# EasyEDA Pro project ProPrj_Avaota A1 八核 AIoT 开发板_2024-05-03.epro, schematic Avaota Pi A, sheets 6 to 13 of 13

## Sheets
6 PERF1
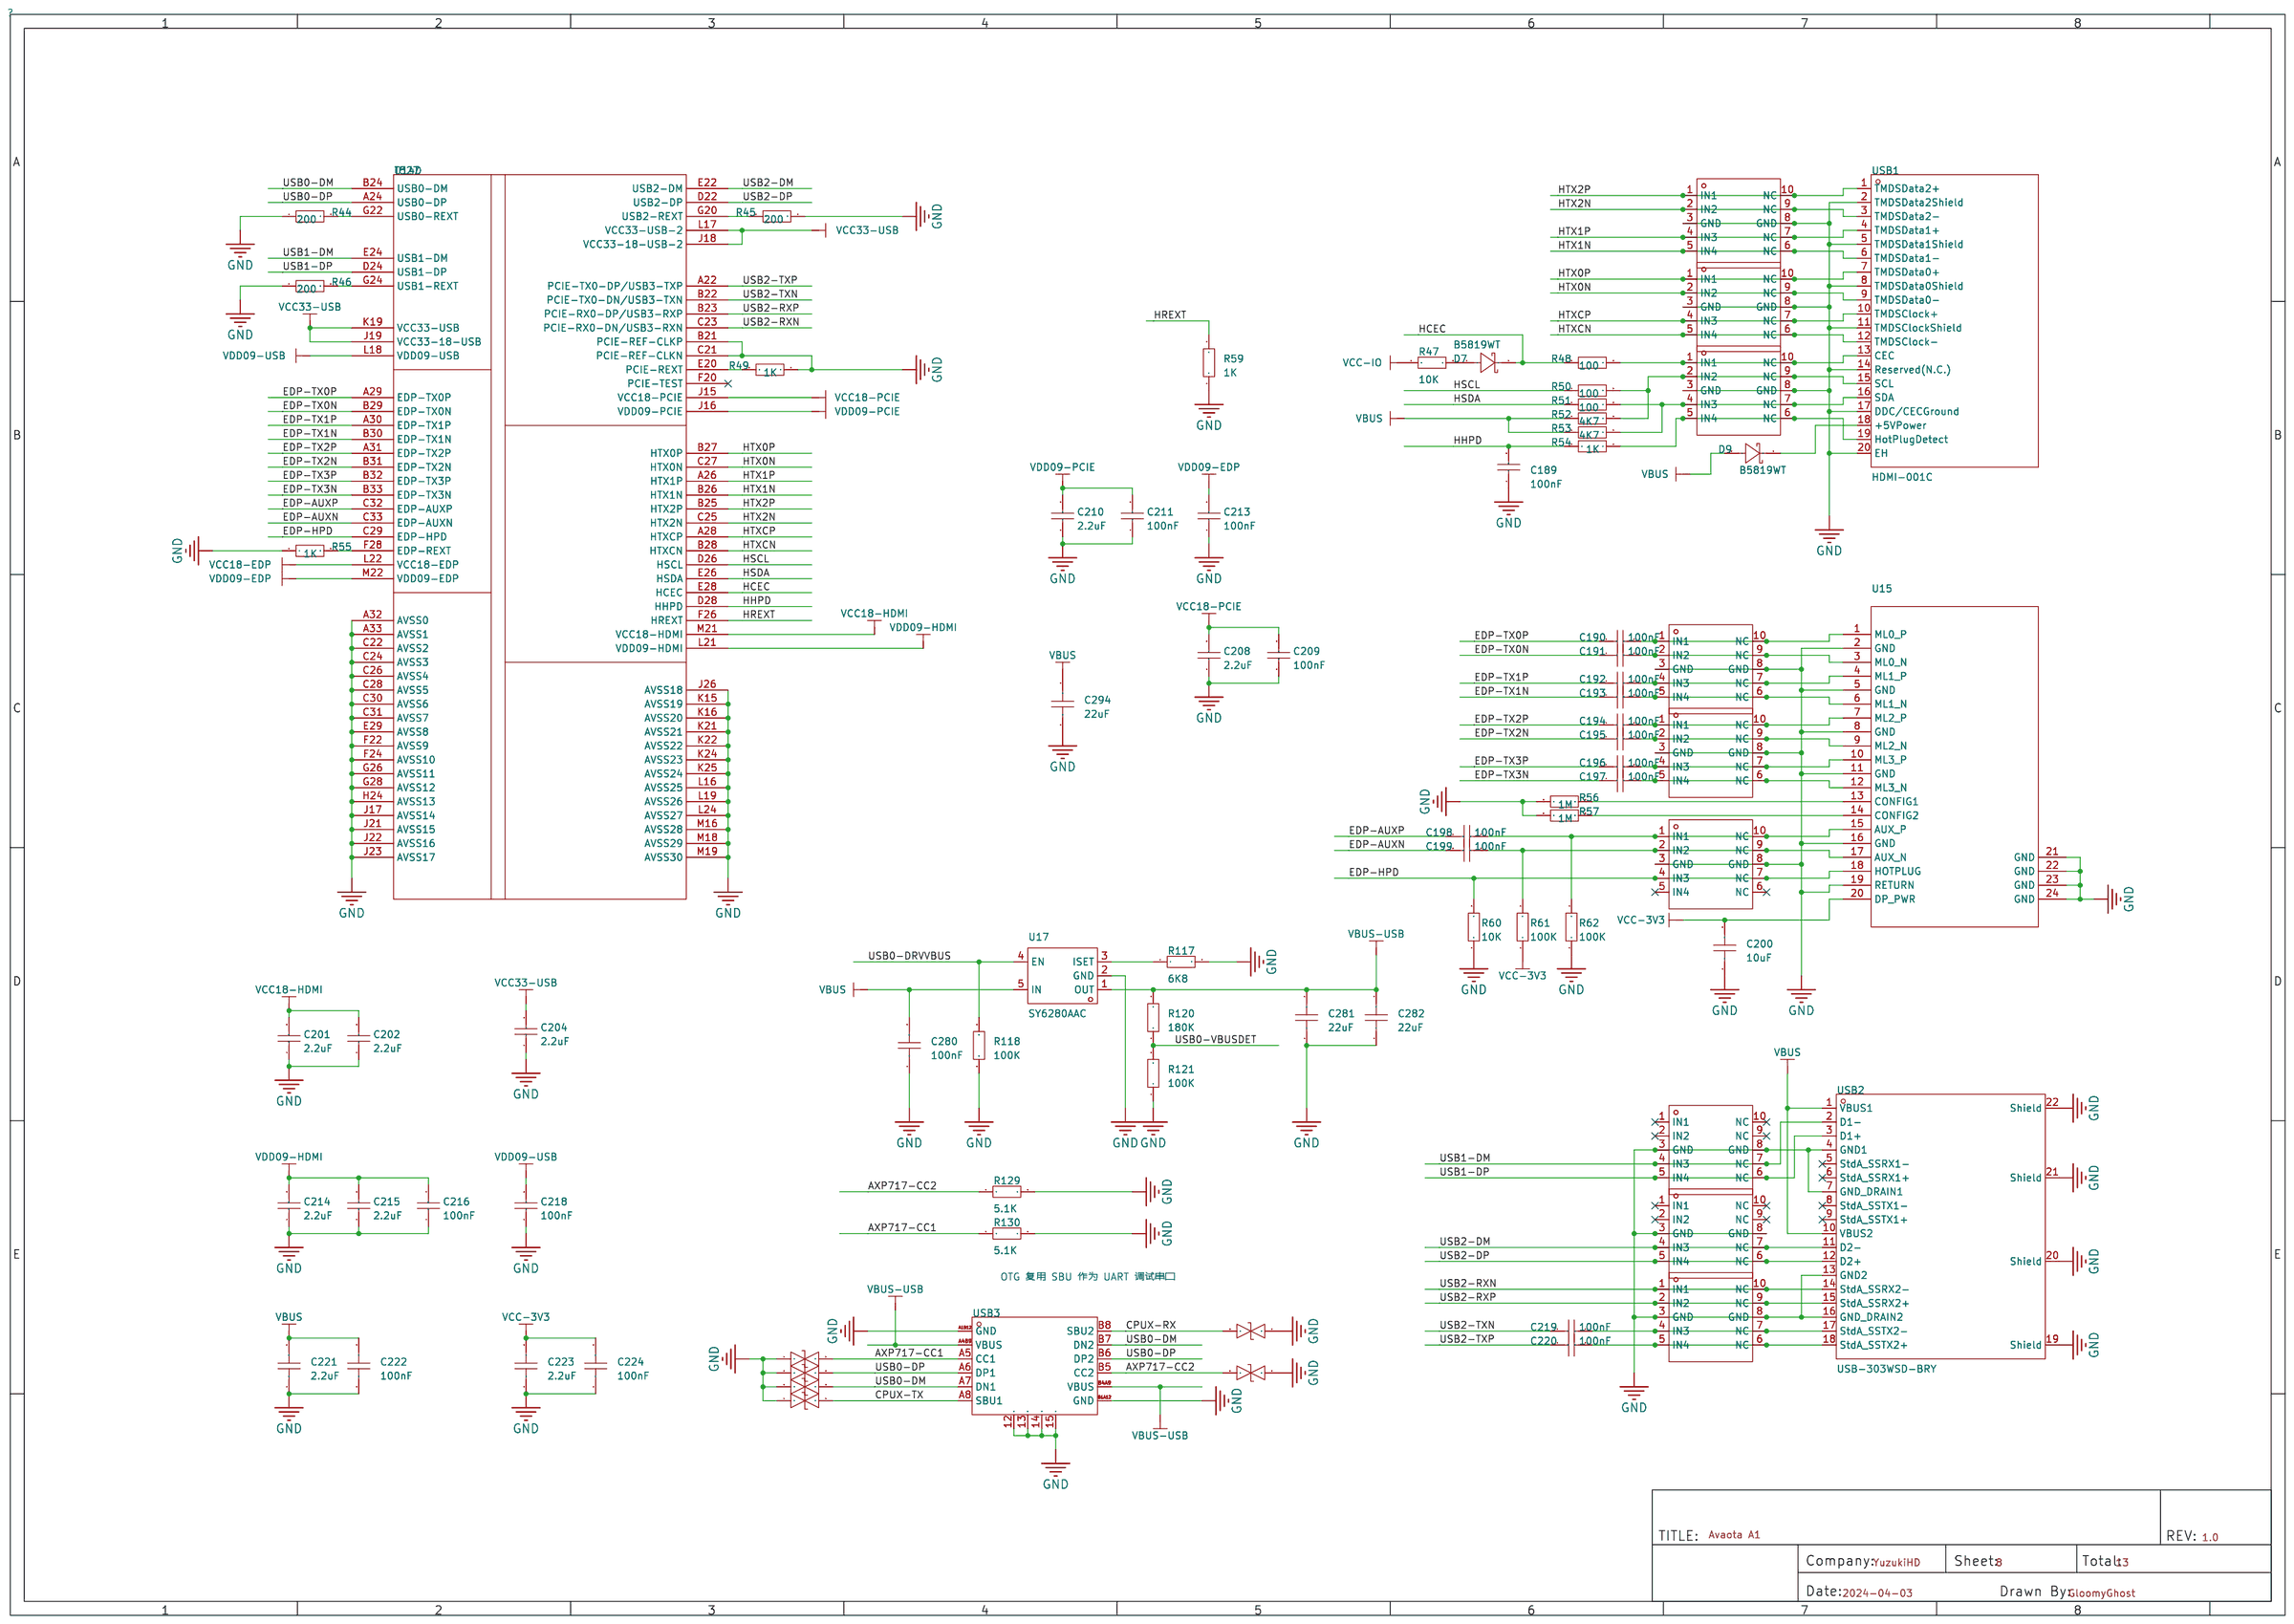
[diagram p5: PERF1]
7 BLOCK
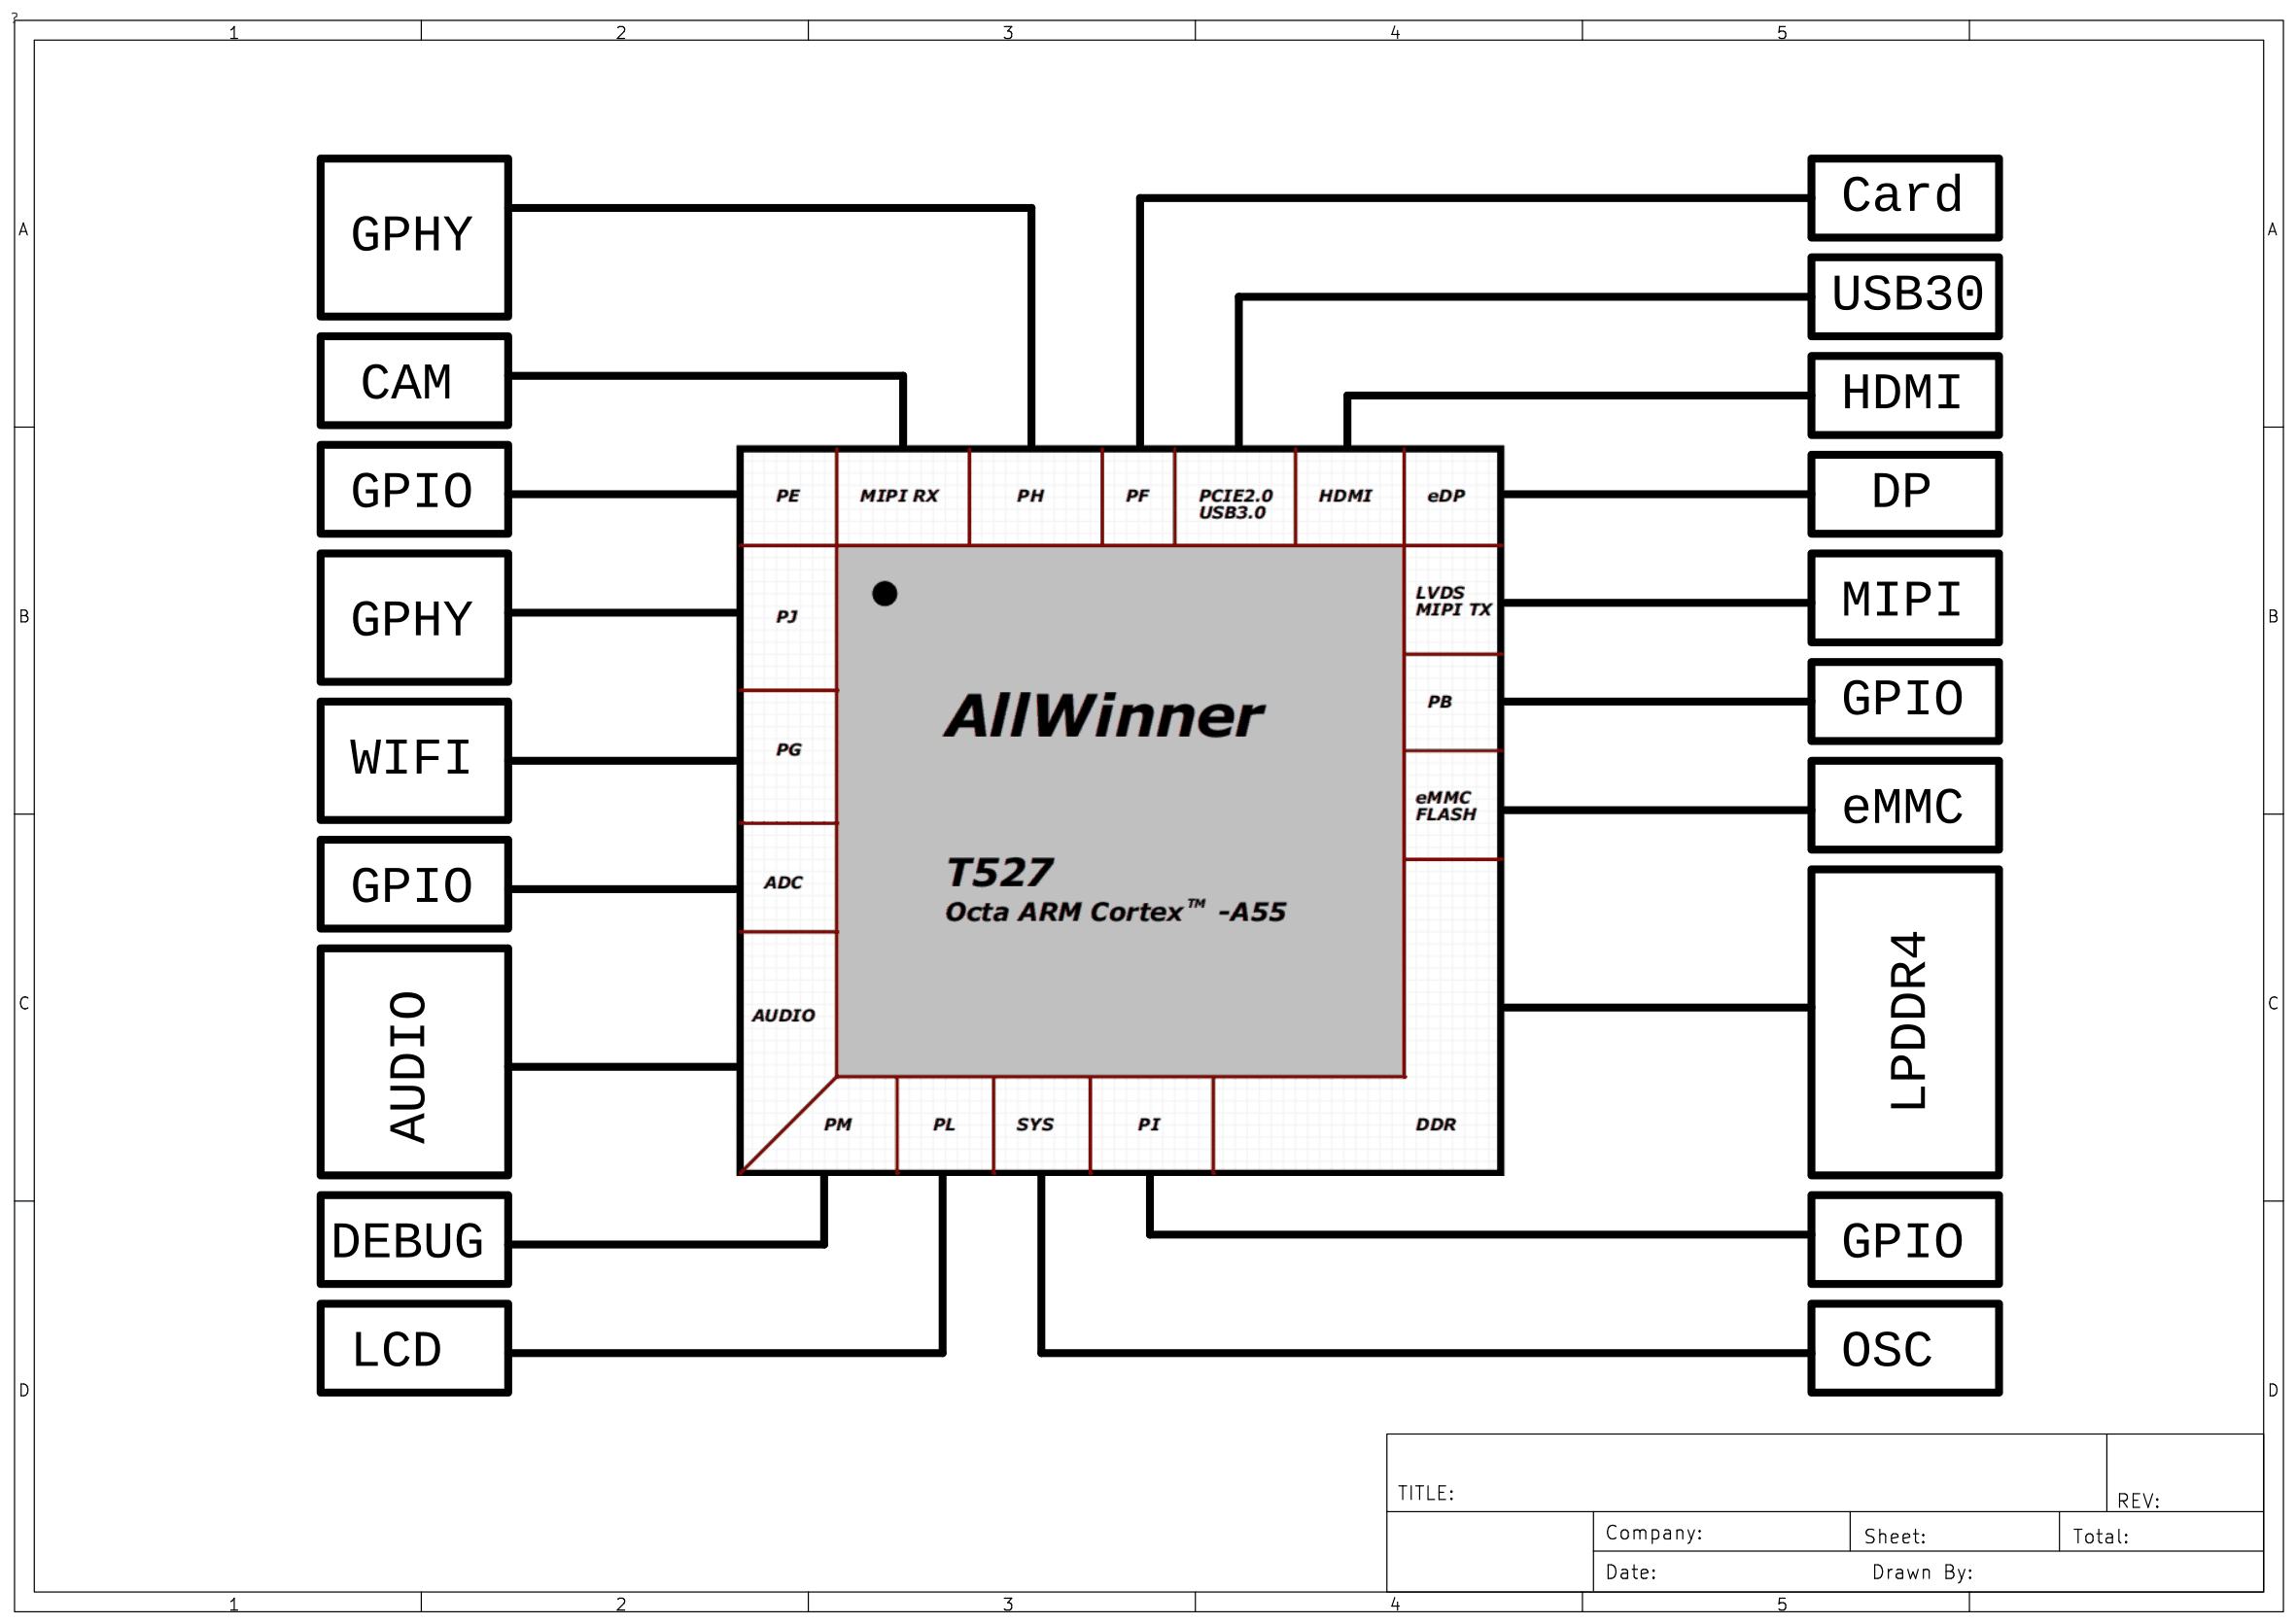
[diagram p6: BLOCK]
8 PERF2
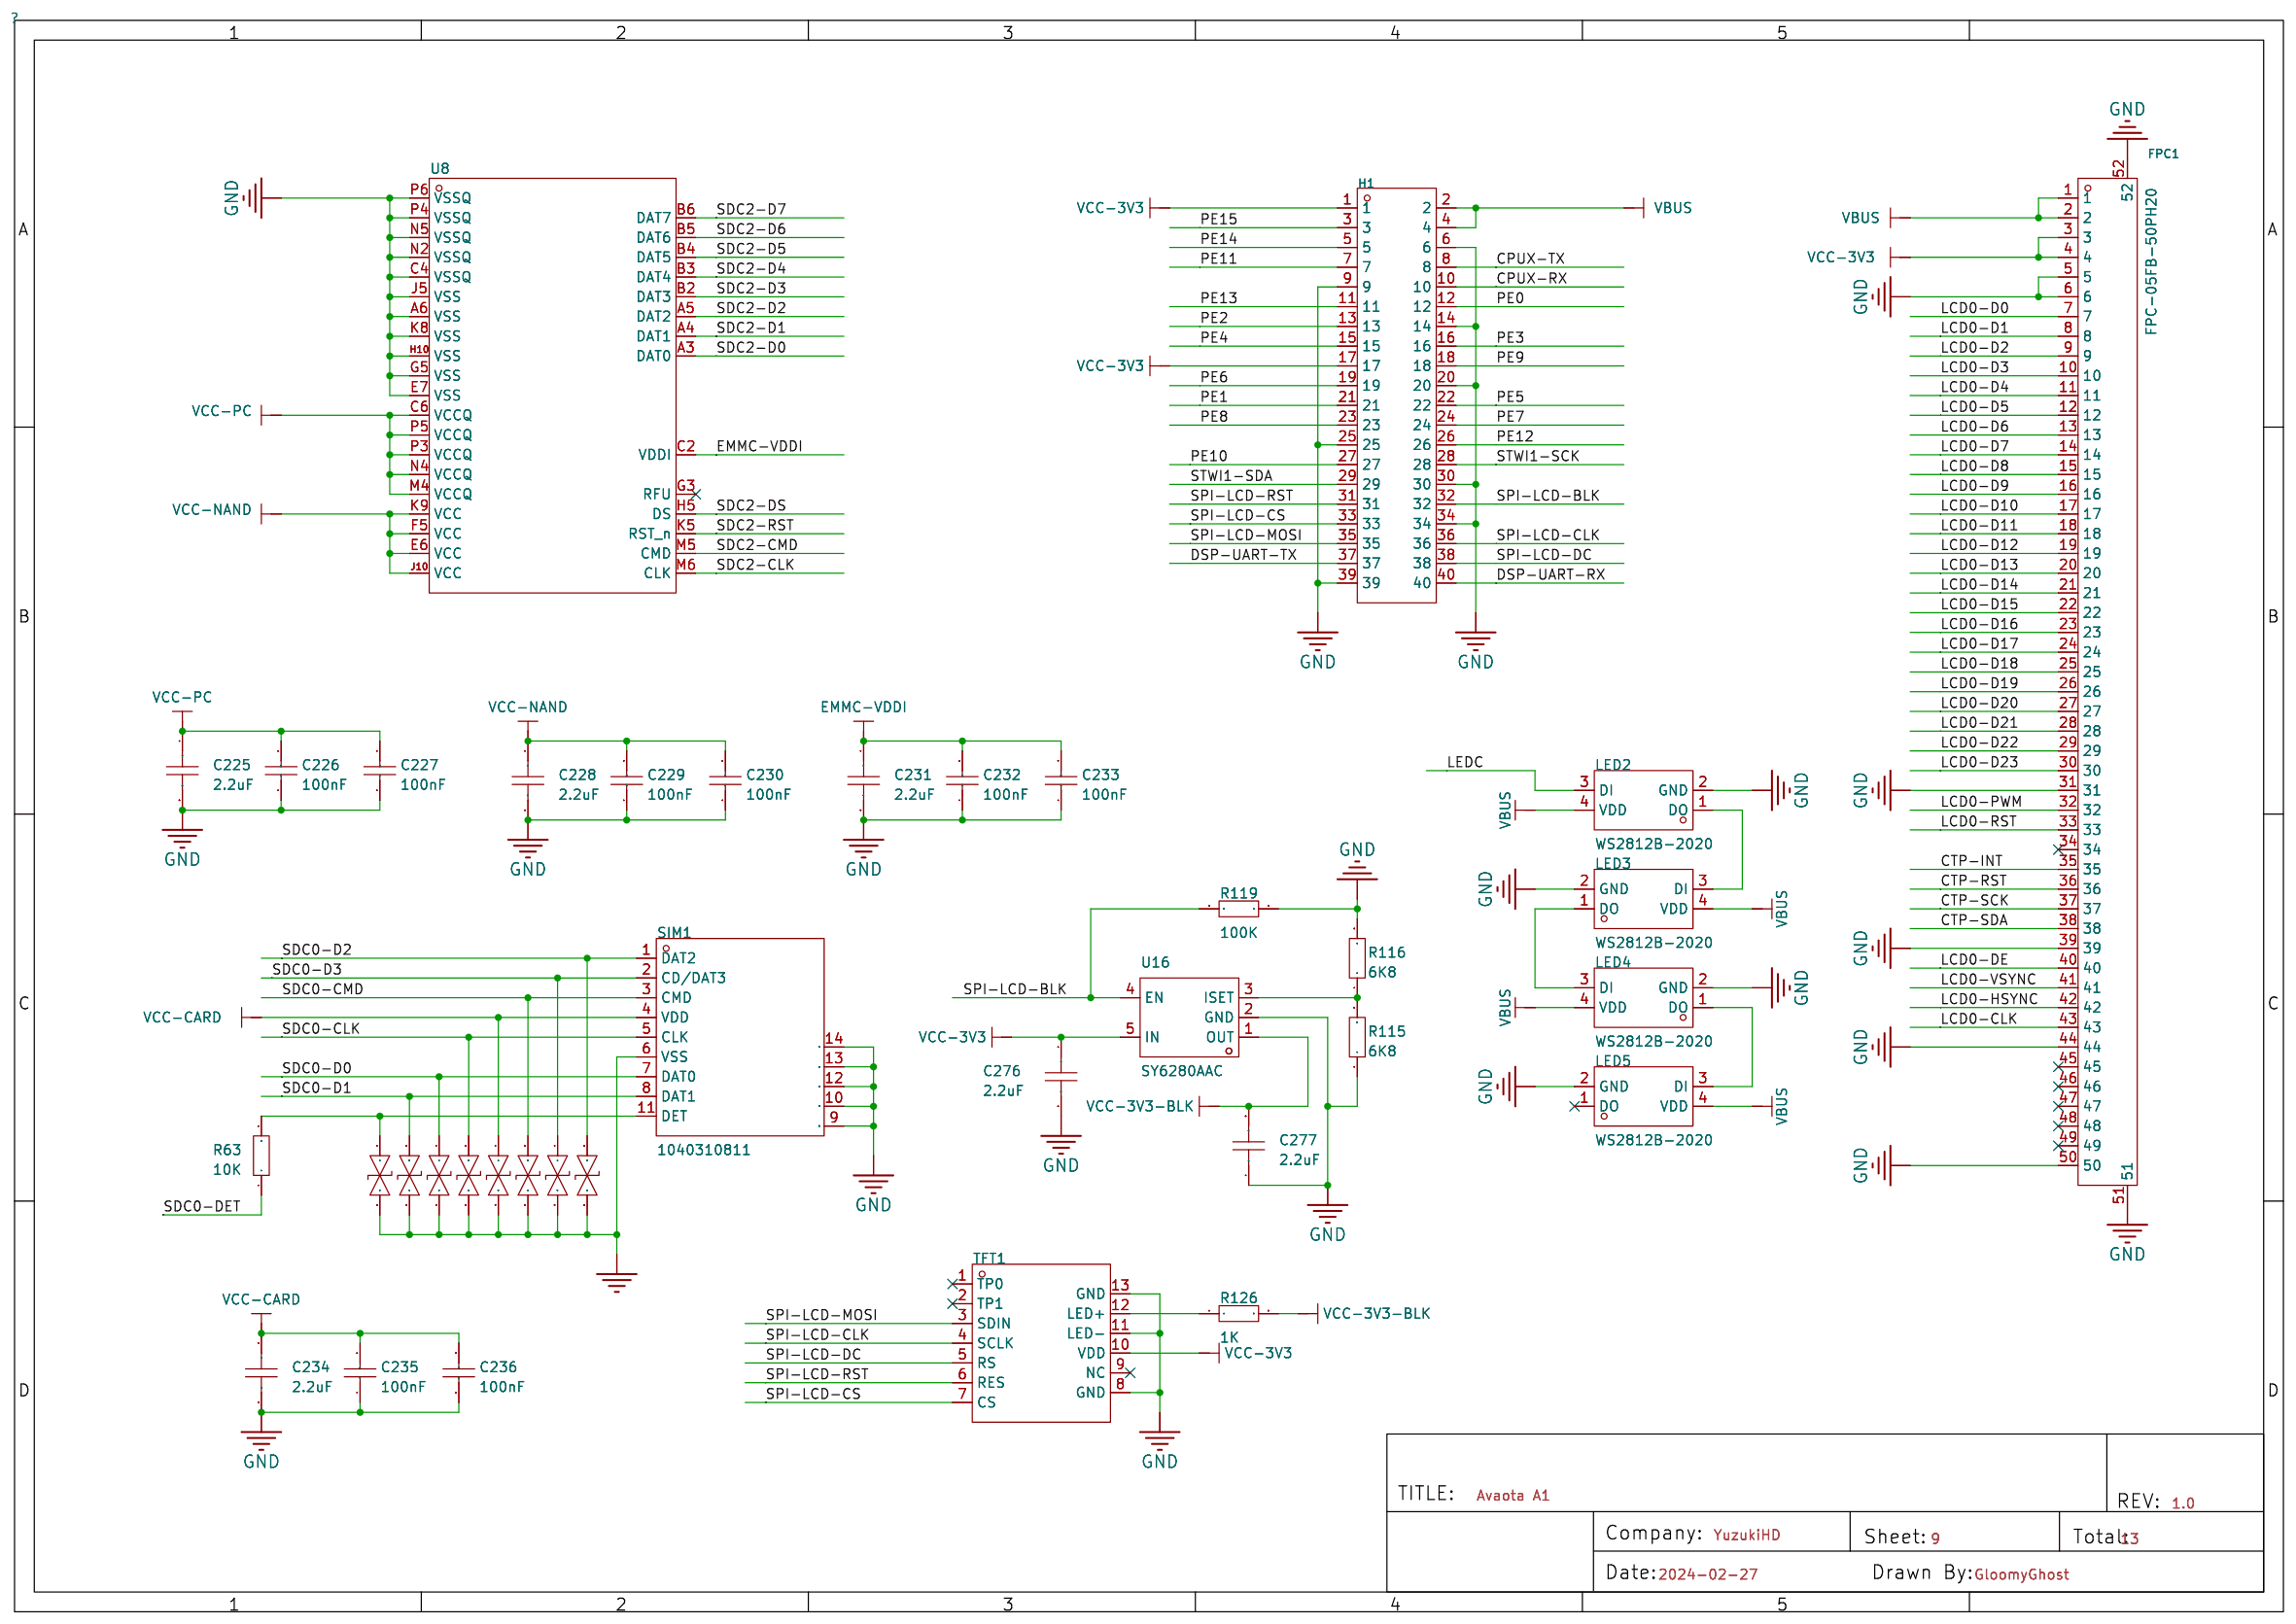
[diagram p7: PERF2]
9 GMAC0
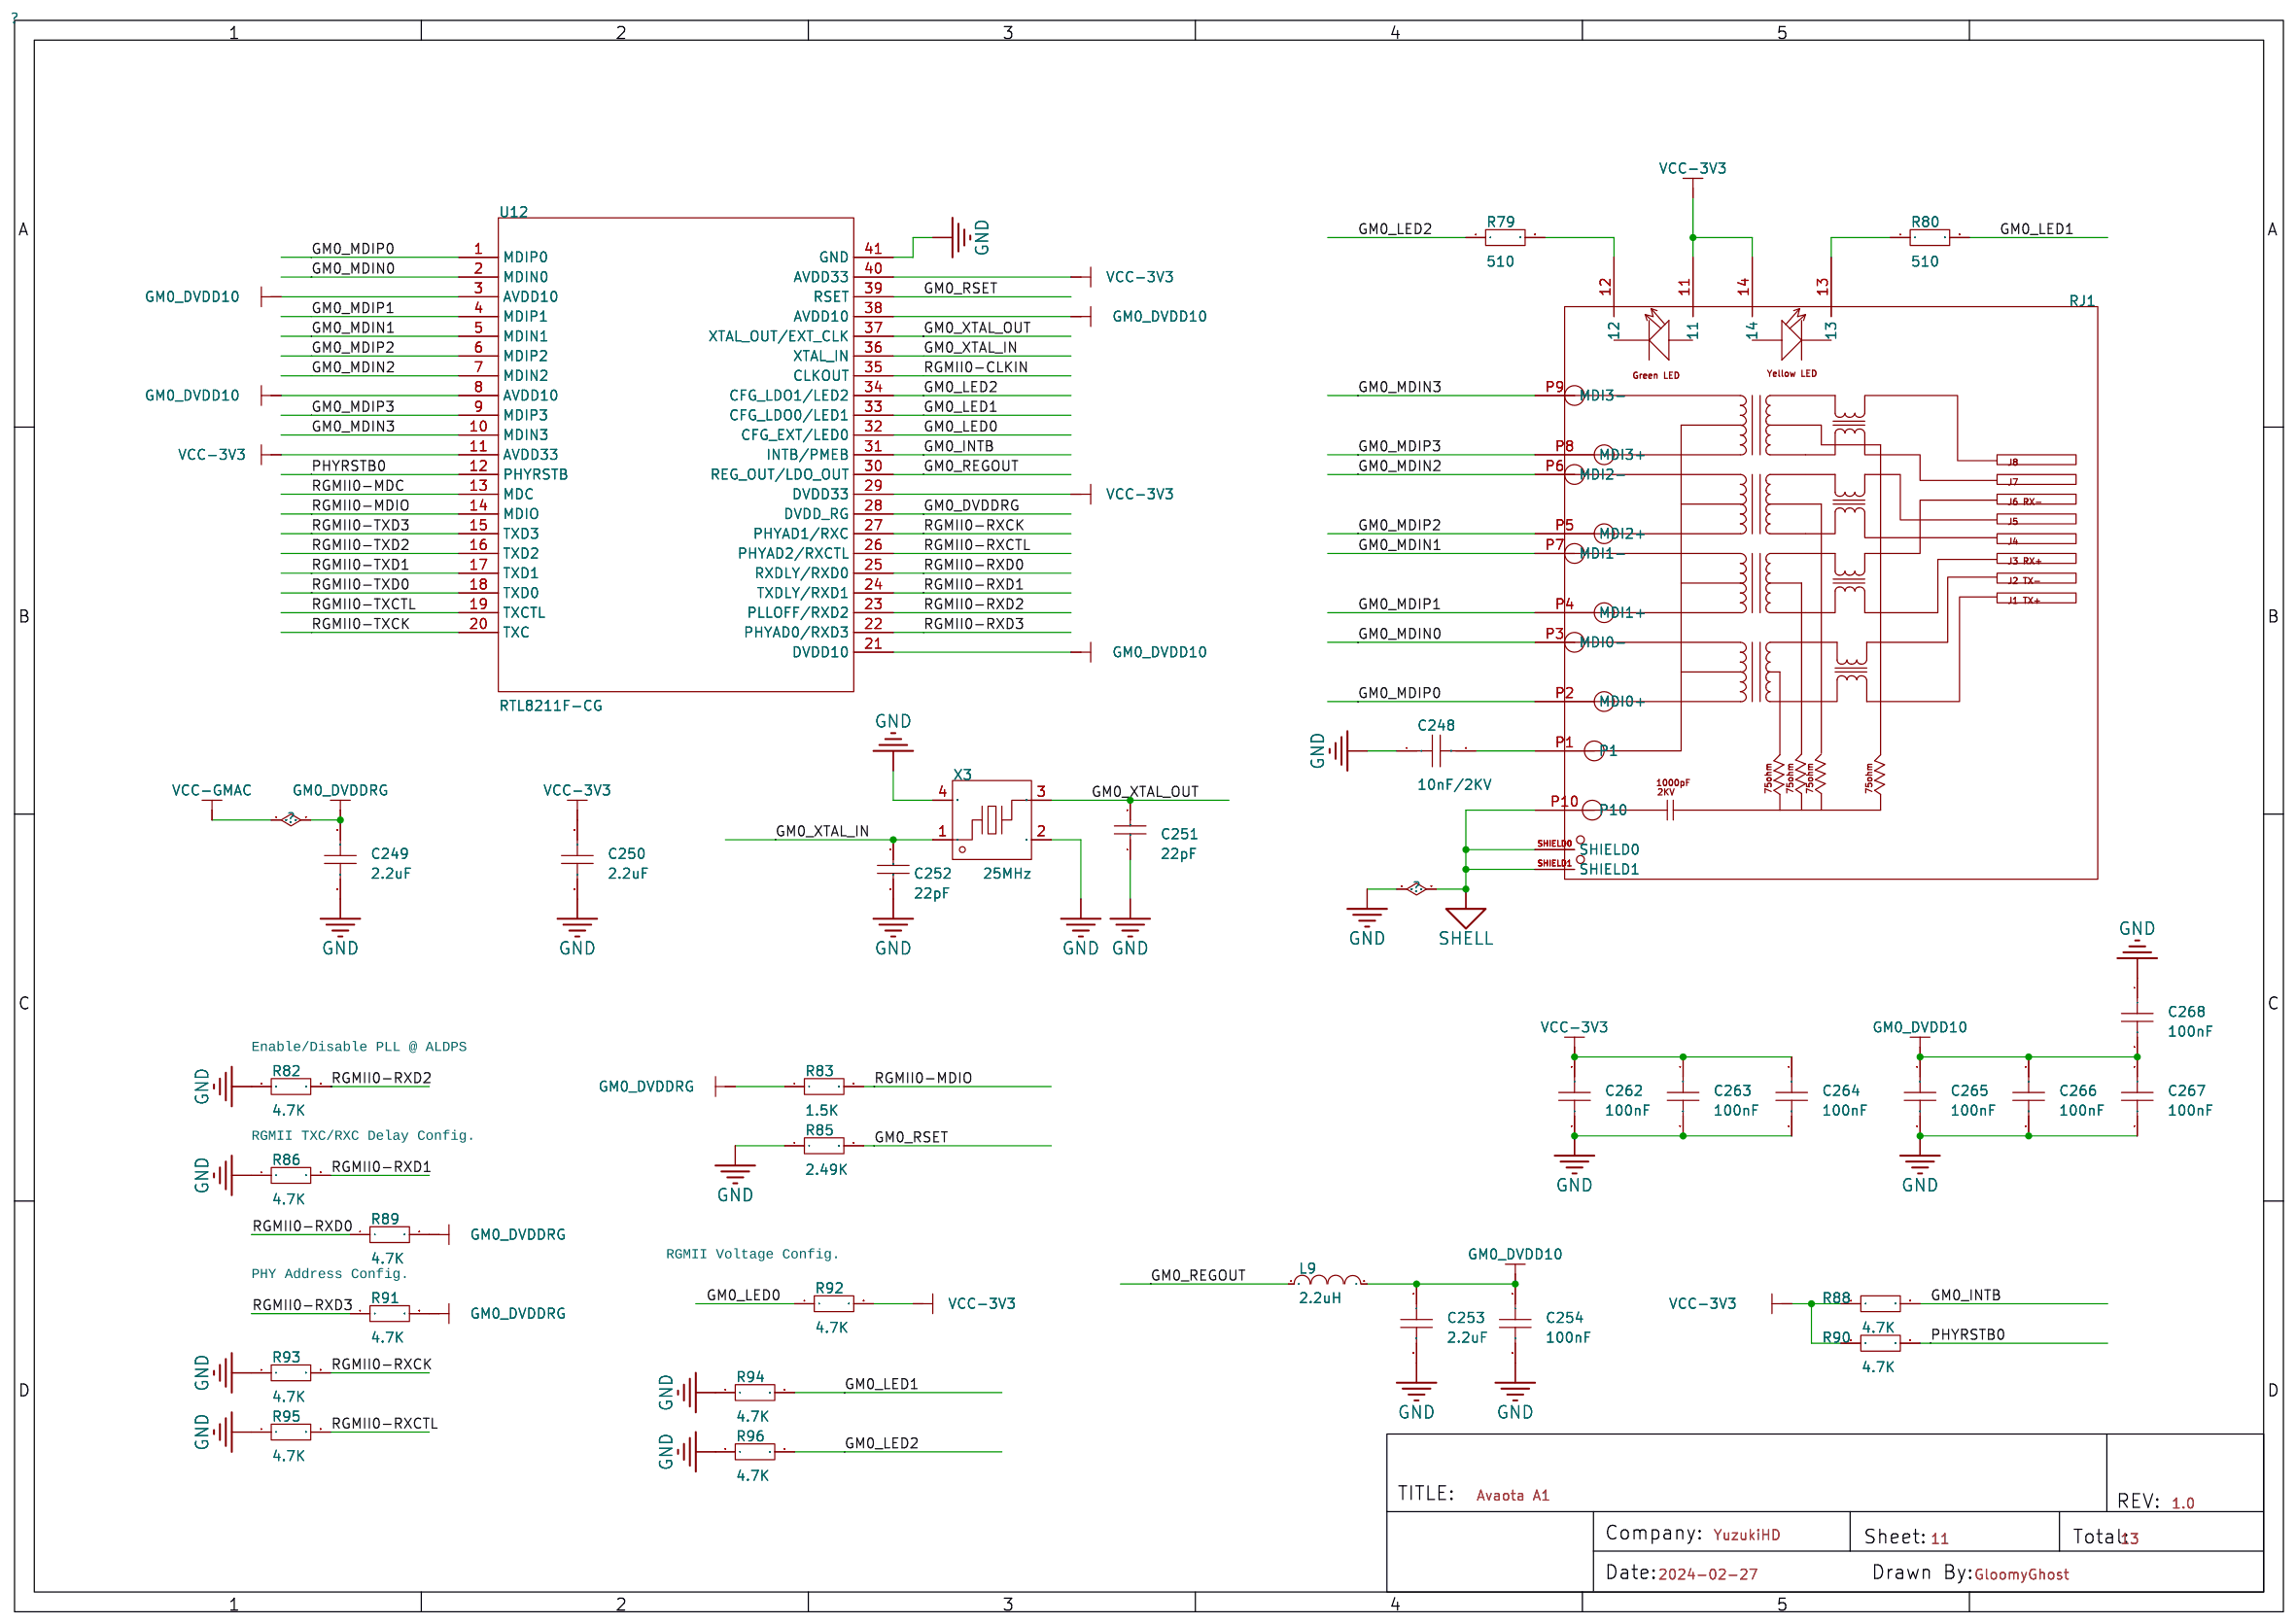
[diagram p8: GMAC0]
10 GMAC1